# Altium schematic sheet fpga.SchDoc (part 2 of 3) (continued)
## Nets (continued)
NetJ5_27: J5.27(US_N) R75.6
NetJ5_28: J5.28(US_P) R73.6
NetJ5_29: J5.29(US_N) R75.5
NetJ5_30: J5.30(US_P) R73.5
NetJ5_31: J5.31(US_N) R120.8
NetJ5_32: J5.32(US_P) R118.8
NetJ5_33: J5.33(US_N) R120.7
NetJ5_34: J5.34(US_P) R118.7
NetJ5_35: J5.35(US_N) R120.6
NetJ5_36: J5.36(US_P) R118.6
NetJ5_37: J5.37(US_N) R120.5
NetJ5_38: J5.38(US_P) R118.5
NetJ5_39: J5.39(US_N) R119.8
NetJ5_40: J5.40(US_P) R117.8
NetJ5_41: J5.41(US_N) R119.7
NetJ5_42: J5.42(US_P) R117.7
NetJ5_43: J5.43(US_N) R119.6
NetJ5_44: J5.44(US_P) R117.6
NetJ5_45: J5.45(US_N) R119.5
NetJ5_46: J5.46(US_P) R117.5
NetJ5_47: J5.47(US_N) R116.8
NetJ5_48: J5.48(US_P) R114.8
NetJ5_49: J5.49(US_N) R116.7
NetJ5_50: J5.50(US_P) R114.7
NetJ5_51: J5.51(US_N) R116.6
NetJ5_52: J5.52(US_P) R114.6
NetJ5_53: J5.53(US_N) R116.5
NetJ5_54: J5.54(US_P) R114.5
NetJ5_55: J5.55(US_N) R115.8
NetJ5_56: J5.56(US_P) R113.8
NetJ5_57: J5.57(US_N) R115.7
NetJ5_58: J5.58(US_P) R113.7
NetJ5_59: J5.59(US_N) R115.6
NetJ5_60: J5.60(US_P) R113.6
NetJ5_61: J5.61(US_N) R115.5
NetJ5_62: J5.62(US_P) R113.5
NetJ5_63: J5.63(US_N) R112.8
NetJ5_64: J5.64(US_P) R110.8
NetJ5_65: J5.65(US_N) R112.7
NetJ5_66: J5.66(US_P) R110.7
NetJ5_67: J5.67(US_N) R112.6
NetJ5_68: J5.68(US_P) R110.6
NetJ5_69: J5.69(US_N) R112.5
NetJ5_70: J5.70(US_P) R110.5
NetJ5_71: J5.71(US_N) R111.8
NetJ5_72: J5.72(US_P) R109.8
NetJ5_73: J5.73(US_N) R111.7
NetJ5_74: J5.74(US_P) R109.7
NetJ5_75: J5.75(US_N) R111.6
NetJ5_76: J5.76(US_P) R109.6
NetJ5_77: J5.77(US_N) R111.5
NetJ5_78: J5.78(US_P) R109.5
NetJ5_79: J5.79(US_N) R108.8
NetJ5_80: J5.80(US_P) R106.8
NetJ5_81: J5.81(US_N) R108.7
NetJ5_82: J5.82(US_P) R106.7
NetJ5_83: J5.83(US_N) R108.6
NetJ5_84: J5.84(US_P) R106.6
NetJ5_85: J5.85(US_N) R108.5
NetJ5_86: J5.86(US_P) R106.5
NetJ5_87: J5.87(US_N) R107.8
NetJ5_88: J5.88(US_P) R105.8
NetJ5_89: J5.89(US_N) R107.7
NetJ5_90: J5.90(US_P) R105.7
NetJ5_91: J5.91(US_N) R107.6
NetJ5_92: J5.92(US_P) R105.6
NetJ5_93: J5.93(US_N) R107.5
NetJ5_94: J5.94(US_P) R105.5
NetJ5_95: J5.95(US_N) R103.5
NetJ5_96: J5.96(US_P) R101.5
NetJ6_7: J6.7(US_N) R103.6
NetJ6_8: J6.8(US_P) R101.6
NetJ6_9: J6.9(US_N) R103.7
NetJ6_10: J6.10(US_P) R101.7
NetJ6_11: J6.11(US_N) R103.8
NetJ6_12: J6.12(US_P) R101.8
NetJ6_13: J6.13(US_N) R104.5
NetJ6_14: J6.14(US_P) R102.5
NetJ6_15: J6.15(US_N) R104.6
NetJ6_16: J6.16(US_P) R102.6
NetJ6_17: J6.17(US_N) R104.7
NetJ6_18: J6.18(US_P) R102.7
NetJ6_19: J6.19(US_N) R104.8
NetJ6_20: J6.20(US_P) R102.8
NetJ6_21: J6.21(US_N) R99.5
NetJ6_22: J6.22(US_P) R97.5
NetJ6_23: J6.23(US_N) R99.6
NetJ6_24: J6.24(US_P) R97.6
NetJ6_25: J6.25(US_N) R99.7
NetJ6_26: J6.26(US_P) R97.7
NetJ6_27: J6.27(US_N) R99.8
NetJ6_28: J6.28(US_P) R97.8
NetJ6_29: J6.29(US_N) R100.5
NetJ6_30: J6.30(US_P) R98.5
NetJ6_31: J6.31(US_N) R100.6
NetJ6_32: J6.32(US_P) R98.6
NetJ6_33: J6.33(US_N) R100.7
NetJ6_34: J6.34(US_P) R98.7
NetJ6_35: J6.35(US_N) R100.8
NetJ6_36: J6.36(US_P) R98.8
NetJ6_37: J6.37(US_N) R135.5
NetJ6_38: J6.38(US_P) R133.5
NetJ6_39: J6.39(US_N) R135.6
NetJ6_40: J6.40(US_P) R133.6
NetJ6_41: J6.41(US_N) R135.7
NetJ6_42: J6.42(US_P) R133.7
NetJ6_43: J6.43(US_N) R135.8
NetJ6_44: J6.44(US_P) R133.8
NetJ6_45: J6.45(US_N) R136.5
NetJ6_46: J6.46(US_P) R134.5
NetJ6_47: J6.47(US_N) R136.6
NetJ6_48: J6.48(US_P) R134.6
NetJ6_49: J6.49(US_N) R136.7
NetJ6_50: J6.50(US_P) R134.7
NetJ6_51: J6.51(US_N) R136.8
NetJ6_52: J6.52(US_P) R134.8
NetJ6_53: J6.53(US_N) R131.5
NetJ6_54: J6.54(US_P) R129.5
NetJ6_55: J6.55(US_N) R131.6
NetJ6_56: J6.56(US_P) R129.6
NetJ6_57: J6.57(US_N) R131.7
NetJ6_58: J6.58(US_P) R129.7
NetJ6_59: J6.59(US_N) R131.8
NetJ6_60: J6.60(US_P) R129.8
NetJ6_61: J6.61(US_N) R132.5
NetJ6_62: J6.62(US_P) R130.5
NetJ6_63: J6.63(US_N) R132.6
NetJ6_64: J6.64(US_P) R130.6
NetJ6_65: J6.65(US_N) R132.7
NetJ6_66: J6.66(US_P) R130.7
NetJ6_67: J6.67(US_N) R132.8
NetJ6_68: J6.68(US_P) R130.8
NetJ6_69: J6.69(US_N) R127.5
NetJ6_70: J6.70(US_P) R125.5
NetJ6_71: J6.71(US_N) R127.6
NetJ6_72: J6.72(US_P) R125.6
NetJ6_73: J6.73(US_N) R127.7
NetJ6_74: J6.74(US_P) R125.7
NetJ6_75: J6.75(US_N) R127.8
NetJ6_76: J6.76(US_P) R125.8
NetJ6_77: J6.77(US_N) R128.5
NetJ6_78: J6.78(US_P) R126.5
NetJ6_79: J6.79(US_N) R128.6
NetJ6_80: J6.80(US_P) R126.6
NetJ6_81: J6.81(US_N) R128.7
NetJ6_82: J6.82(US_P) R126.7
NetJ6_83: J6.83(US_N) R128.8
NetJ6_84: J6.84(US_P) R126.8
NetJ6_85: J6.85(US_N) R123.5
NetJ6_86: J6.86(US_P) R121.5
NetJ6_87: J6.87(US_N) R123.6
NetJ6_88: J6.88(US_P) R121.6
NetJ6_89: J6.89(US_N) R123.7
NetJ6_90: J6.90(US_P) R121.7
NetJ6_91: J6.91(US_N) R123.8
NetJ6_92: J6.92(US_P) R121.8
NetJ6_93: J6.93(US_N) R124.5
NetJ6_94: J6.94(US_P) R122.5
NetJ6_95: J6.95(US_N) R124.6
NetJ6_96: J6.96(US_P) R122.6
NetJ7_7: J7.7(US_N) R124.7
NetJ7_8: J7.8(US_P) R122.7
NetJ7_9: J7.9(US_N) R124.8
NetJ7_10: J7.10(US_P) R122.8
NetJ7_11: J7.11(US_N) R144.8
NetJ7_12: J7.12(US_P) R142.8
NetJ7_13: J7.13(US_N) R144.7
NetJ7_14: J7.14(US_P) R142.7
NetJ7_15: J7.15(US_N) R144.6
NetJ7_16: J7.16(US_P) R142.6
NetJ7_17: J7.17(US_N) R144.5
NetJ7_18: J7.18(US_P) R142.5
NetJ7_19: J7.19(US_N) R143.8
NetJ7_20: J7.20(US_P) R141.8
NetJ7_21: J7.21(US_N) R143.7
NetJ7_22: J7.22(US_P) R141.7
NetJ7_23: J7.23(US_N) R143.6
NetJ7_24: J7.24(US_P) R141.6
NetJ7_25: J7.25(US_N) R143.5
NetJ7_26: J7.26(US_P) R141.5
NetJ7_27: J7.27(US_N) R140.8
NetJ7_28: J7.28(US_P) R138.8
NetJ7_29: J7.29(US_N) R140.7
NetJ7_30: J7.30(US_P) R138.7
NetJ7_31: J7.31(US_N) R140.6
NetJ7_32: J7.32(US_P) R138.6
NetJ7_33: J7.33(US_N) R140.5
NetJ7_34: J7.34(US_P) R138.5
NetJ7_35: J7.35(US_N) R139.8
NetJ7_36: J7.36(US_P) R137.8
NetJ7_37: J7.37(US_N) R139.7
NetJ7_38: J7.38(US_P) R137.7
NetJ7_39: J7.39(US_N) R139.6
NetJ7_40: J7.40(US_P) R137.6
NetJ7_41: J7.41(US_N) R139.5
NetJ7_42: J7.42(US_P) R137.5
NetJ7_43: J7.43(US_N) R156.8
NetJ7_44: J7.44(US_P) R154.8
NetJ7_45: J7.45(US_N) R156.7
NetJ7_46: J7.46(US_P) R154.7
NetJ7_47: J7.47(US_N) R156.6
NetJ7_48: J7.48(US_P) R154.6
NetJ7_49: J7.49(US_N) R156.5
NetJ7_50: J7.50(US_P) R154.5
NetJ7_51: J7.51(US_N) R155.8
NetJ7_52: J7.52(US_P) R153.8
NetJ7_53: J7.53(US_N) R155.7
NetJ7_54: J7.54(US_P) R153.7
NetJ7_55: J7.55(US_N) R155.6
NetJ7_56: J7.56(US_P) R153.6
NetJ7_57: J7.57(US_N) R155.5
NetJ7_58: J7.58(US_P) R153.5
NetJ7_59: J7.59(US_N) R152.8
NetJ7_60: J7.60(US_P) R150.8
NetJ7_61: J7.61(US_N) R152.7
NetJ7_62: J7.62(US_P) R150.7
NetJ7_63: J7.63(US_N) R152.6
NetJ7_64: J7.64(US_P) R150.6
NetJ7_65: J7.65(US_N) R152.5
NetJ7_66: J7.66(US_P) R150.5
NetJ7_67: J7.67(US_N) R151.8
NetJ7_68: J7.68(US_P) R149.8
NetJ7_69: J7.69(US_N) R151.7
NetJ7_70: J7.70(US_P) R149.7
NetJ7_71: J7.71(US_N) R151.6
NetJ7_72: J7.72(US_P) R149.6
NetJ7_73: J7.73(US_N) R151.5
NetJ7_74: J7.74(US_P) R149.5
NetJ7_75: J7.75(US_N) R148.8
NetJ7_76: J7.76(US_P) R146.8
NetJ7_77: J7.77(US_N) R148.7
NetJ7_78: J7.78(US_P) R146.7
NetJ7_79: J7.79(US_N) R148.6
NetJ7_80: J7.80(US_P) R146.6
NetJ7_81: J7.81(US_N) R148.5
NetJ7_82: J7.82(US_P) R146.5
NetJ7_83: J7.83(US_N) R147.8
NetJ7_84: J7.84(US_P) R145.8
NetJ7_85: J7.85(US_N) R147.7
NetJ7_86: J7.86(US_P) R145.7
NetJ7_87: J7.87(US_N) R147.6
NetJ7_88: J7.88(US_P) R145.6
NetJ7_89: J7.89(US_N) R147.5
NetJ7_90: J7.90(US_P) R145.5
NetJ7_91: J7.91(US_N) R167.5
NetJ7_92: J7.92(US_P) R165.5
NetJ7_93: J7.93(US_N) R167.6
NetJ7_94: J7.94(US_P) R165.6
NetJ7_95: J7.95(US_N) R167.7
NetJ7_96: J7.96(US_P) R165.7
NetJ8_7: J8.7(US_N) R167.8
NetJ8_8: J8.8(US_P) R165.8
NetJ8_9: J8.9(US_N) R168.5
NetJ8_10: J8.10(US_P) R166.5
NetJ8_11: J8.11(US_N) R168.6
NetJ8_12: J8.12(US_P) R166.6
NetJ8_13: J8.13(US_N) R168.7
NetJ8_14: J8.14(US_P) R166.7
NetJ8_15: J8.15(US_N) R168.8
NetJ8_16: J8.16(US_P) R166.8
NetJ8_17: J8.17(US_N) R163.5
NetJ8_18: J8.18(US_P) R161.5
NetJ8_19: J8.19(US_N) R163.6
NetJ8_20: J8.20(US_P) R161.6
NetJ8_21: J8.21(US_N) R163.7
NetJ8_22: J8.22(US_P) R161.7
NetJ8_23: J8.23(US_N) R163.8
NetJ8_24: J8.24(US_P) R161.8
NetJ8_25: J8.25(US_N) R164.5
NetJ8_26: J8.26(US_P) R162.5
NetJ8_27: J8.27(US_N) R164.6
NetJ8_28: J8.28(US_P) R162.6
NetJ8_29: J8.29(US_N) R164.7
NetJ8_30: J8.30(US_P) R162.7
NetJ8_31: J8.31(US_N) R164.8
NetJ8_32: J8.32(US_P) R162.8
NetJ8_33: J8.33(US_N) R159.5
NetJ8_34: J8.34(US_P) R157.5
NetJ8_35: J8.35(US_N) R159.6
NetJ8_36: J8.36(US_P) R157.6
NetJ8_37: J8.37(US_N) R159.7
NetJ8_38: J8.38(US_P) R157.7
NetJ8_39: J8.39(US_N) R159.8
NetJ8_40: J8.40(US_P) R157.8
NetJ8_41: J8.41(US_N) R160.5
NetJ8_42: J8.42(US_P) R158.5
NetJ8_43: J8.43(US_N) R160.6
NetJ8_44: J8.44(US_P) R158.6
NetJ8_45: J8.45(US_N) R160.7
NetJ8_46: J8.46(US_P) R158.7
NetJ8_47: J8.47(US_N) R160.8
NetJ8_48: J8.48(US_P) R158.8
NetJ8_49: J8.49(US_N) R179.5
NetJ8_50: J8.50(US_P) R177.5
NetJ8_51: J8.51(US_N) R179.6
NetJ8_52: J8.52(US_P) R177.6
NetJ8_53: J8.53(US_N) R179.7
NetJ8_54: J8.54(US_P) R177.7
NetJ8_55: J8.55(US_N) R179.8
NetJ8_56: J8.56(US_P) R177.8
NetJ8_57: J8.57(US_N) R180.5
NetJ8_58: J8.58(US_P) R178.5
NetJ8_59: J8.59(US_N) R180.6
NetJ8_60: J8.60(US_P) R178.6
NetJ8_61: J8.61(US_N) R180.7
NetJ8_62: J8.62(US_P) R178.7
NetJ8_63: J8.63(US_N) R180.8
NetJ8_64: J8.64(US_P) R178.8
NetJ8_65: J8.65(US_N) R175.5
NetJ8_66: J8.66(US_P) R173.5
NetJ8_67: J8.67(US_N) R175.6
NetJ8_68: J8.68(US_P) R173.6
NetJ8_69: J8.69(US_N) R175.7
NetJ8_70: J8.70(US_P) R173.7
NetJ8_71: J8.71(US_N) R175.8
NetJ8_72: J8.72(US_P) R173.8
NetJ8_73: J8.73(US_N) R176.5
NetJ8_74: J8.74(US_P) R174.5
NetJ8_75: J8.75(US_N) R176.6
NetJ8_76: J8.76(US_P) R174.6
NetJ8_77: J8.77(US_N) R176.7
NetJ8_78: J8.78(US_P) R174.7
NetJ8_79: J8.79(US_N) R176.8
NetJ8_80: J8.80(US_P) R174.8
NetJ8_81: J8.81(US_N) R171.5
NetJ8_82: J8.82(US_P) R169.5
NetJ8_83: J8.83(US_N) R171.6
NetJ8_84: J8.84(US_P) R169.6
NetJ8_85: J8.85(US_N) R171.7
NetJ8_86: J8.86(US_P) R169.7
NetJ8_87: J8.87(US_N) R171.8
NetJ8_88: J8.88(US_P) R169.8
NetJ8_89: J8.89(US_N) R172.5
NetJ8_90: J8.90(US_P) R170.5
NetJ8_91: J8.91(US_N) R172.6
NetJ8_92: J8.92(US_P) R170.6
NetJ8_93: J8.93(US_N) R172.7
NetJ8_94: J8.94(US_P) R170.7
NetJ8_95: J8.95(US_N) R172.8
NetJ8_96: J8.96(US_P) R170.8
NetR1_1: R1.1 U1.3(QD)
NetR1_2: R1.2 U1.2(QC)
NetR1_3: R1.3 U1.1(QB)
NetR1_4: R1.4 U1.15(QA)
NetR2_1: R2.1 U2.3(QD)
NetR2_2: R2.2 U2.2(QC)
NetR2_3: R2.3 U2.1(QB)
NetR2_4: R2.4 U2.15(QA)
NetR3_1: R3.1 U1.7(QH)
NetR3_2: R3.2 U1.6(QG)
NetR3_3: R3.3 U1.5(QF)
NetR3_4: R3.4 U1.4(QE)
NetR4_1: R4.1 U2.7(QH)
NetR4_2: R4.2 U2.6(QG)
NetR4_3: R4.3 U2.5(QF)
NetR4_4: R4.4 U2.4(QE)
NetR5_1: R5.1 U3.3(QD)
NetR5_2: R5.2 U3.2(QC)
NetR5_3: R5.3 U3.1(QB)
NetR5_4: R5.4 U3.15(QA)
NetR6_1: R6.1 U4.3(QD)
NetR6_2: R6.2 U4.2(QC)
NetR6_3: R6.3 U4.1(QB)
NetR6_4: R6.4 U4.15(QA)
NetR7_1: R7.1 U3.7(QH)
NetR7_2: R7.2 U3.6(QG)
NetR7_3: R7.3 U3.5(QF)
NetR7_4: R7.4 U3.4(QE)
NetR8_1: R8.1 U4.7(QH)
NetR8_2: R8.2 U4.6(QG)
NetR8_3: R8.3 U4.5(QF)
NetR8_4: R8.4 U4.4(QE)
NetR9_1: R9.1 U5.3(QD)
NetR9_2: R9.2 U5.2(QC)
NetR9_3: R9.3 U5.1(QB)
NetR9_4: R9.4 U5.15(QA)
NetR10_1: R10.1 U6.3(QD)
NetR10_2: R10.2 U6.2(QC)
NetR10_3: R10.3 U6.1(QB)
NetR10_4: R10.4 U6.15(QA)
NetR11_1: R11.1 U5.7(QH)
NetR11_2: R11.2 U5.6(QG)
NetR11_3: R11.3 U5.5(QF)
NetR11_4: R11.4 U5.4(QE)
NetR12_1: R12.1 U6.7(QH)
NetR12_2: R12.2 U6.6(QG)
NetR12_3: R12.3 U6.5(QF)
NetR12_4: R12.4 U6.4(QE)
NetR13_1: R13.1 U7.3(QD)
NetR13_2: R13.2 U7.2(QC)
NetR13_3: R13.3 U7.1(QB)
NetR13_4: R13.4 U7.15(QA)
NetR14_1: R14.1 U8.3(QD)
NetR14_2: R14.2 U8.2(QC)
NetR14_3: R14.3 U8.1(QB)
NetR14_4: R14.4 U8.15(QA)
NetR15_1: R15.1 U7.7(QH)
NetR15_2: R15.2 U7.6(QG)
NetR15_3: R15.3 U7.5(QF)
NetR15_4: R15.4 U7.4(QE)
NetR16_1: R16.1 U8.7(QH)
NetR16_2: R16.2 U8.6(QG)
NetR16_3: R16.3 U8.5(QF)
NetR16_4: R16.4 U8.4(QE)
NetR17_1: R17.1 U9.3(QD)
NetR17_2: R17.2 U9.2(QC)
NetR17_3: R17.3 U9.1(QB)
NetR17_4: R17.4 U9.15(QA)
NetR18_1: R18.1 U10.3(QD)
NetR18_2: R18.2 U10.2(QC)
NetR18_3: R18.3 U10.1(QB)
NetR18_4: R18.4 U10.15(QA)
NetR19_1: R19.1 U9.7(QH)
NetR19_2: R19.2 U9.6(QG)
NetR19_3: R19.3 U9.5(QF)
NetR19_4: R19.4 U9.4(QE)
NetR20_1: R20.1 U10.7(QH)
NetR20_2: R20.2 U10.6(QG)
NetR20_3: R20.3 U10.5(QF)
NetR20_4: R20.4 U10.4(QE)
NetR21_1: R21.1 U11.3(QD)
NetR21_2: R21.2 U11.2(QC)
NetR21_3: R21.3 U11.1(QB)
NetR21_4: R21.4 U11.15(QA)
NetR22_1: R22.1 U12.3(QD)
NetR22_2: R22.2 U12.2(QC)
NetR22_3: R22.3 U12.1(QB)
NetR22_4: R22.4 U12.15(QA)
NetR23_1: R23.1 U11.7(QH)
NetR23_2: R23.2 U11.6(QG)
NetR23_3: R23.3 U11.5(QF)
NetR23_4: R23.4 U11.4(QE)
NetR24_1: R24.1 U12.7(QH)
NetR24_2: R24.2 U12.6(QG)
NetR24_3: R24.3 U12.5(QF)
NetR24_4: R24.4 U12.4(QE)
NetR25_1: R25.1 U13.3(QD)
NetR25_2: R25.2 U13.2(QC)
NetR25_3: R25.3 U13.1(QB)
NetR25_4: R25.4 U13.15(QA)
NetR26_1: R26.1 U14.3(QD)
NetR26_2: R26.2 U14.2(QC)
NetR26_3: R26.3 U14.1(QB)
NetR26_4: R26.4 U14.15(QA)
NetR27_1: R27.1 U13.7(QH)
NetR27_2: R27.2 U13.6(QG)
NetR27_3: R27.3 U13.5(QF)
NetR27_4: R27.4 U13.4(QE)
NetR28_1: R28.1 U14.7(QH)
NetR28_2: R28.2 U14.6(QG)
NetR28_3: R28.3 U14.5(QF)
NetR28_4: R28.4 U14.4(QE)
NetR29_1: R29.1 U15.3(QD)
NetR29_2: R29.2 U15.2(QC)
NetR29_3: R29.3 U15.1(QB)
NetR29_4: R29.4 U15.15(QA)
NetR30_1: R30.1 U16.3(QD)
NetR30_2: R30.2 U16.2(QC)
NetR30_3: R30.3 U16.1(QB)
NetR30_4: R30.4 U16.15(QA)
NetR31_1: R31.1 U15.7(QH)
NetR31_2: R31.2 U15.6(QG)
NetR31_3: R31.3 U15.5(QF)
NetR31_4: R31.4 U15.4(QE)
NetR32_1: R32.1 U16.7(QH)
NetR32_2: R32.2 U16.6(QG)
NetR32_3: R32.3 U16.5(QF)
NetR32_4: R32.4 U16.4(QE)
NetR33_1: R33.1 U17.3(QD)
NetR33_2: R33.2 U17.2(QC)
NetR33_3: R33.3 U17.1(QB)
NetR33_4: R33.4 U17.15(QA)
NetR34_1: R34.1 U18.3(QD)
NetR34_2: R34.2 U18.2(QC)
NetR34_3: R34.3 U18.1(QB)
NetR34_4: R34.4 U18.15(QA)
NetR35_1: R35.1 U17.7(QH)
NetR35_2: R35.2 U17.6(QG)
NetR35_3: R35.3 U17.5(QF)
NetR35_4: R35.4 U17.4(QE)
NetR36_1: R36.1 U18.7(QH)
NetR36_2: R36.2 U18.6(QG)
NetR36_3: R36.3 U18.5(QF)
NetR36_4: R36.4 U18.4(QE)
NetR37_1: R37.1 U19.3(QD)
NetR37_2: R37.2 U19.2(QC)
NetR37_3: R37.3 U19.1(QB)
NetR37_4: R37.4 U19.15(QA)
NetR38_1: R38.1 U20.3(QD)
NetR38_2: R38.2 U20.2(QC)
NetR38_3: R38.3 U20.1(QB)
NetR38_4: R38.4 U20.15(QA)
NetR39_1: R39.1 U19.7(QH)
NetR39_2: R39.2 U19.6(QG)
NetR39_3: R39.3 U19.5(QF)
NetR39_4: R39.4 U19.4(QE)
NetR40_1: R40.1 U20.7(QH)
NetR40_2: R40.2 U20.6(QG)
NetR40_3: R40.3 U20.5(QF)
NetR40_4: R40.4 U20.4(QE)
NetR41_1: R41.1 U21.3(QD)
NetR41_2: R41.2 U21.2(QC)
NetR41_3: R41.3 U21.1(QB)
NetR41_4: R41.4 U21.15(QA)
NetR42_1: R42.1 U22.3(QD)
NetR42_2: R42.2 U22.2(QC)
NetR42_3: R42.3 U22.1(QB)
NetR42_4: R42.4 U22.15(QA)
NetR43_1: R43.1 U21.7(QH)
NetR43_2: R43.2 U21.6(QG)
NetR43_3: R43.3 U21.5(QF)
NetR43_4: R43.4 U21.4(QE)
NetR44_1: R44.1 U22.7(QH)
NetR44_2: R44.2 U22.6(QG)
NetR44_3: R44.3 U22.5(QF)
NetR44_4: R44.4 U22.4(QE)
NetR45_1: R45.1 U23.3(QD)
NetR45_2: R45.2 U23.2(QC)
NetR45_3: R45.3 U23.1(QB)
NetR45_4: R45.4 U23.15(QA)
NetR46_1: R46.1 U24.3(QD)
NetR46_2: R46.2 U24.2(QC)
NetR46_3: R46.3 U24.1(QB)
NetR46_4: R46.4 U24.15(QA)
NetR47_1: R47.1 U23.7(QH)
NetR47_2: R47.2 U23.6(QG)
NetR47_3: R47.3 U23.5(QF)
NetR47_4: R47.4 U23.4(QE)
NetR48_1: R48.1 U24.7(QH)
NetR48_2: R48.2 U24.6(QG)
NetR48_3: R48.3 U24.5(QF)
NetR48_4: R48.4 U24.4(QE)
NetR49_1: R49.1 U27.3(QD)
NetR49_2: R49.2 U27.2(QC)
NetR49_3: R49.3 U27.1(QB)
NetR49_4: R49.4 U27.15(QA)
NetR50_1: R50.1 U27.7(QH)
NetR50_2: R50.2 U27.6(QG)
NetR50_3: R50.3 U27.5(QF)
NetR50_4: R50.4 U27.4(QE)
NetR51_1: R51.1 U28.3(QD)
NetR51_2: R51.2 U28.2(QC)
NetR51_3: R51.3 U28.1(QB)
NetR51_4: R51.4 U28.15(QA)
NetR52_1: R52.1 U28.7(QH)
NetR52_2: R52.2 U28.6(QG)
NetR52_3: R52.3 U28.5(QF)
NetR52_4: R52.4 U28.4(QE)
NetR53_1: R53.1 U29.3(QD)
NetR53_2: R53.2 U29.2(QC)
NetR53_3: R53.3 U29.1(QB)
NetR53_4: R53.4 U29.15(QA)
NetR54_1: R54.1 U29.7(QH)
NetR54_2: R54.2 U29.6(QG)
NetR54_3: R54.3 U29.5(QF)
NetR54_4: R54.4 U29.4(QE)
NetR55_1: R55.1 U30.3(QD)
NetR55_2: R55.2 U30.2(QC)
NetR55_3: R55.3 U30.1(QB)
NetR55_4: R55.4 U30.15(QA)
NetR56_1: R56.1 U30.7(QH)
NetR56_2: R56.2 U30.6(QG)
NetR56_3: R56.3 U30.5(QF)
NetR56_4: R56.4 U30.4(QE)
NetR57_1: R57.1 U31.3(QD)
NetR57_2: R57.2 U31.2(QC)
NetR57_3: R57.3 U31.1(QB)
NetR57_4: R57.4 U31.15(QA)
NetR58_1: R58.1 U31.7(QH)
NetR58_2: R58.2 U31.6(QG)
NetR58_3: R58.3 U31.5(QF)
NetR58_4: R58.4 U31.4(QE)
NetR59_1: R59.1 U32.3(QD)
NetR59_2: R59.2 U32.2(QC)
NetR59_3: R59.3 U32.1(QB)
NetR59_4: R59.4 U32.15(QA)
NetR60_1: R60.1 U32.7(QH)
NetR60_2: R60.2 U32.6(QG)
NetR60_3: R60.3 U32.5(QF)
NetR60_4: R60.4 U32.4(QE)
NetR61_1: R61.1 U33.3(QD)
NetR61_2: R61.2 U33.2(QC)
NetR61_3: R61.3 U33.1(QB)
NetR61_4: R61.4 U33.15(QA)
NetR62_1: R62.1 U33.7(QH)
NetR62_2: R62.2 U33.6(QG)
NetR62_3: R62.3 U33.5(QF)
NetR62_4: R62.4 U33.4(QE)
NetR63_1: R63.1 U34.3(QD)
NetR63_2: R63.2 U34.2(QC)
NetR63_3: R63.3 U34.1(QB)
NetR63_4: R63.4 U34.15(QA)
NetR64_1: R64.1 U34.7(QH)
NetR64_2: R64.2 U34.6(QG)
NetR64_3: R64.3 U34.5(QF)
NetR64_4: R64.4 U34.4(QE)
NetR65_1: R65.1 U35.3(QD)
NetR65_2: R65.2 U35.2(QC)
NetR65_3: R65.3 U35.1(QB)
NetR65_4: R65.4 U35.15(QA)
NetR66_1: R66.1 U35.7(QH)
NetR66_2: R66.2 U35.6(QG)
NetR66_3: R66.3 U35.5(QF)
NetR66_4: R66.4 U35.4(QE)
NetR67_1: R67.1 U36.3(QD)
NetR67_2: R67.2 U36.2(QC)
NetR67_3: R67.3 U36.1(QB)
NetR67_4: R67.4 U36.15(QA)
NetR68_1: R68.1 U36.7(QH)
NetR68_2: R68.2 U36.6(QG)
NetR68_3: R68.3 U36.5(QF)
NetR68_4: R68.4 U36.4(QE)
NetR69_1: R69.1 U37.3(QD)
NetR69_2: R69.2 U37.2(QC)
NetR69_3: R69.3 U37.1(QB)
NetR69_4: R69.4 U37.15(QA)
NetR70_1: R70.1 U37.7(QH)
NetR70_2: R70.2 U37.6(QG)
NetR70_3: R70.3 U37.5(QF)
NetR70_4: R70.4 U37.4(QE)
NetR71_1: R71.1 U38.3(QD)
NetR71_2: R71.2 U38.2(QC)
NetR71_3: R71.3 U38.1(QB)
NetR71_4: R71.4 U38.15(QA)
NetR72_1: R72.1 U38.7(QH)
NetR72_2: R72.2 U38.6(QG)
NetR72_3: R72.3 U38.5(QF)
NetR72_4: R72.4 U38.4(QE)
NetR73_1: R73.1 U39.3(QD)
NetR73_2: R73.2 U39.2(QC)
NetR73_3: R73.3 U39.1(QB)
NetR73_4: R73.4 U39.15(QA)
NetR74_1: R74.1 U39.7(QH)
NetR74_2: R74.2 U39.6(QG)
NetR74_3: R74.3 U39.5(QF)
NetR74_4: R74.4 U39.4(QE)
NetR75_1: R75.1 U40.3(QD)
NetR75_2: R75.2 U40.2(QC)
NetR75_3: R75.3 U40.1(QB)
NetR75_4: R75.4 U40.15(QA)
NetR76_1: R76.1 U40.7(QH)
NetR76_2: R76.2 U40.6(QG)
NetR76_3: R76.3 U40.5(QF)
NetR76_4: R76.4 U40.4(QE)
NetR77_1: R77.1 U41.3(QD)
NetR77_2: R77.2 U41.2(QC)
NetR77_3: R77.3 U41.1(QB)
NetR77_4: R77.4 U41.15(QA)
NetR78_1: R78.1 U41.7(QH)
NetR78_2: R78.2 U41.6(QG)
NetR78_3: R78.3 U41.5(QF)
NetR78_4: R78.4 U41.4(QE)
NetR79_1: R79.1 U42.3(QD)
NetR79_2: R79.2 U42.2(QC)
NetR79_3: R79.3 U42.1(QB)
NetR79_4: R79.4 U42.15(QA)
NetR80_1: R80.1 U42.7(QH)
NetR80_2: R80.2 U42.6(QG)
NetR80_3: R80.3 U42.5(QF)
NetR80_4: R80.4 U42.4(QE)
NetR81_1: R81.1 U43.3(QD)
NetR81_2: R81.2 U43.2(QC)
NetR81_3: R81.3 U43.1(QB)
NetR81_4: R81.4 U43.15(QA)
NetR82_1: R82.1 U43.7(QH)
NetR82_2: R82.2 U43.6(QG)
NetR82_3: R82.3 U43.5(QF)
NetR82_4: R82.4 U43.4(QE)
NetR83_1: R83.1 U44.3(QD)
NetR83_2: R83.2 U44.2(QC)
NetR83_3: R83.3 U44.1(QB)
NetR83_4: R83.4 U44.15(QA)
NetR84_1: R84.1 U44.7(QH)
NetR84_2: R84.2 U44.6(QG)
NetR84_3: R84.3 U44.5(QF)
NetR84_4: R84.4 U44.4(QE)
NetR85_1: R85.1 U45.3(QD)
NetR85_2: R85.2 U45.2(QC)
NetR85_3: R85.3 U45.1(QB)
NetR85_4: R85.4 U45.15(QA)
NetR86_1: R86.1 U45.7(QH)
NetR86_2: R86.2 U45.6(QG)
NetR86_3: R86.3 U45.5(QF)
NetR86_4: R86.4 U45.4(QE)
NetR87_1: R87.1 U46.3(QD)
NetR87_2: R87.2 U46.2(QC)
NetR87_3: R87.3 U46.1(QB)
NetR87_4: R87.4 U46.15(QA)
NetR88_1: R88.1 U46.7(QH)
NetR88_2: R88.2 U46.6(QG)
NetR88_3: R88.3 U46.5(QF)
NetR88_4: R88.4 U46.4(QE)
NetR89_1: R89.1 U47.3(QD)
NetR89_2: R89.2 U47.2(QC)
NetR89_3: R89.3 U47.1(QB)
NetR89_4: R89.4 U47.15(QA)
NetR90_1: R90.1 U47.7(QH)
NetR90_2: R90.2 U47.6(QG)
NetR90_3: R90.3 U47.5(QF)
NetR90_4: R90.4 U47.4(QE)
NetR91_1: R91.1 U48.3(QD)
NetR91_2: R91.2 U48.2(QC)
NetR91_3: R91.3 U48.1(QB)
NetR91_4: R91.4 U48.15(QA)
NetR92_1: R92.1 U48.7(QH)
NetR92_2: R92.2 U48.6(QG)
NetR92_3: R92.3 U48.5(QF)
NetR92_4: R92.4 U48.4(QE)
NetR93_1: R93.1 U49.3(QD)
NetR93_2: R93.2 U49.2(QC)
NetR93_3: R93.3 U49.1(QB)
NetR93_4: R93.4 U49.15(QA)
NetR94_1: R94.1 U49.7(QH)
NetR94_2: R94.2 U49.6(QG)
NetR94_3: R94.3 U49.5(QF)
NetR94_4: R94.4 U49.4(QE)
NetR95_1: R95.1 U50.3(QD)
NetR95_2: R95.2 U50.2(QC)
NetR95_3: R95.3 U50.1(QB)
NetR95_4: R95.4 U50.15(QA)
NetR96_1: R96.1 U50.7(QH)
NetR96_2: R96.2 U50.6(QG)
NetR96_3: R96.3 U50.5(QF)
NetR96_4: R96.4 U50.4(QE)
NetR97_1: R97.1 U51.3(QD)
NetR97_2: R97.2 U51.2(QC)
NetR97_3: R97.3 U51.1(QB)
NetR97_4: R97.4 U51.15(QA)
NetR98_1: R98.1 U51.7(QH)
NetR98_2: R98.2 U51.6(QG)
NetR98_3: R98.3 U51.5(QF)
NetR98_4: R98.4 U51.4(QE)
NetR99_1: R99.1 U52.3(QD)
NetR99_2: R99.2 U52.2(QC)
NetR99_3: R99.3 U52.1(QB)
NetR99_4: R99.4 U52.15(QA)
NetR100_1: R100.1 U52.7(QH)
NetR100_2: R100.2 U52.6(QG)
NetR100_3: R100.3 U52.5(QF)
NetR100_4: R100.4 U52.4(QE)
NetR101_1: R101.1 U53.3(QD)
NetR101_2: R101.2 U53.2(QC)
NetR101_3: R101.3 U53.1(QB)
NetR101_4: R101.4 U53.15(QA)
NetR102_1: R102.1 U53.7(QH)
NetR102_2: R102.2 U53.6(QG)
NetR102_3: R102.3 U53.5(QF)
NetR102_4: R102.4 U53.4(QE)
NetR103_1: R103.1 U54.3(QD)
NetR103_2: R103.2 U54.2(QC)
NetR103_3: R103.3 U54.1(QB)
NetR103_4: R103.4 U54.15(QA)
NetR104_1: R104.1 U54.7(QH)
NetR104_2: R104.2 U54.6(QG)
NetR104_3: R104.3 U54.5(QF)
NetR104_4: R104.4 U54.4(QE)
NetR105_1: R105.1 U55.3(QD)
NetR105_2: R105.2 U55.2(QC)
NetR105_3: R105.3 U55.1(QB)
NetR105_4: R105.4 U55.15(QA)
NetR106_1: R106.1 U55.7(QH)
NetR106_2: R106.2 U55.6(QG)
NetR106_3: R106.3 U55.5(QF)
NetR106_4: R106.4 U55.4(QE)
NetR107_1: R107.1 U56.3(QD)
NetR107_2: R107.2 U56.2(QC)
NetR107_3: R107.3 U56.1(QB)
NetR107_4: R107.4 U56.15(QA)
NetR108_1: R108.1 U56.7(QH)
NetR108_2: R108.2 U56.6(QG)
NetR108_3: R108.3 U56.5(QF)
NetR108_4: R108.4 U56.4(QE)
NetR109_1: R109.1 U57.3(QD)
NetR109_2: R109.2 U57.2(QC)
NetR109_3: R109.3 U57.1(QB)
NetR109_4: R109.4 U57.15(QA)
NetR110_1: R110.1 U57.7(QH)
NetR110_2: R110.2 U57.6(QG)
NetR110_3: R110.3 U57.5(QF)
NetR110_4: R110.4 U57.4(QE)
NetR111_1: R111.1 U58.3(QD)
NetR111_2: R111.2 U58.2(QC)
NetR111_3: R111.3 U58.1(QB)
NetR111_4: R111.4 U58.15(QA)
NetR112_1: R112.1 U58.7(QH)
NetR112_2: R112.2 U58.6(QG)
NetR112_3: R112.3 U58.5(QF)
NetR112_4: R112.4 U58.4(QE)
NetR113_1: R113.1 U59.3(QD)
NetR113_2: R113.2 U59.2(QC)
NetR113_3: R113.3 U59.1(QB)
NetR113_4: R113.4 U59.15(QA)
NetR114_1: R114.1 U59.7(QH)
NetR114_2: R114.2 U59.6(QG)
NetR114_3: R114.3 U59.5(QF)
NetR114_4: R114.4 U59.4(QE)
NetR115_1: R115.1 U60.3(QD)
NetR115_2: R115.2 U60.2(QC)
NetR115_3: R115.3 U60.1(QB)
NetR115_4: R115.4 U60.15(QA)
NetR116_1: R116.1 U60.7(QH)
NetR116_2: R116.2 U60.6(QG)
NetR116_3: R116.3 U60.5(QF)
NetR116_4: R116.4 U60.4(QE)
NetR117_1: R117.1 U61.3(QD)
NetR117_2: R117.2 U61.2(QC)
NetR117_3: R117.3 U61.1(QB)
NetR117_4: R117.4 U61.15(QA)
NetR118_1: R118.1 U61.7(QH)
NetR118_2: R118.2 U61.6(QG)
NetR118_3: R118.3 U61.5(QF)
NetR118_4: R118.4 U61.4(QE)
NetR119_1: R119.1 U62.3(QD)
NetR119_2: R119.2 U62.2(QC)
NetR119_3: R119.3 U62.1(QB)
NetR119_4: R119.4 U62.15(QA)
NetR120_1: R120.1 U62.7(QH)
NetR120_2: R120.2 U62.6(QG)
NetR120_3: R120.3 U62.5(QF)
NetR120_4: R120.4 U62.4(QE)
NetR121_1: R121.1 U63.3(QD)
NetR121_2: R121.2 U63.2(QC)
NetR121_3: R121.3 U63.1(QB)
NetR121_4: R121.4 U63.15(QA)
NetR122_1: R122.1 U63.7(QH)
NetR122_2: R122.2 U63.6(QG)
NetR122_3: R122.3 U63.5(QF)
NetR122_4: R122.4 U63.4(QE)
NetR123_1: R123.1 U64.3(QD)
NetR123_2: R123.2 U64.2(QC)
NetR123_3: R123.3 U64.1(QB)
NetR123_4: R123.4 U64.15(QA)
NetR124_1: R124.1 U64.7(QH)
NetR124_2: R124.2 U64.6(QG)
NetR124_3: R124.3 U64.5(QF)
NetR124_4: R124.4 U64.4(QE)
NetR125_1: R125.1 U65.3(QD)
NetR125_2: R125.2 U65.2(QC)
NetR125_3: R125.3 U65.1(QB)
NetR125_4: R125.4 U65.15(QA)
NetR126_1: R126.1 U65.7(QH)
NetR126_2: R126.2 U65.6(QG)
NetR126_3: R126.3 U65.5(QF)
NetR126_4: R126.4 U65.4(QE)
NetR127_1: R127.1 U66.3(QD)
NetR127_2: R127.2 U66.2(QC)
NetR127_3: R127.3 U66.1(QB)
NetR127_4: R127.4 U66.15(QA)
NetR128_1: R128.1 U66.7(QH)
NetR128_2: R128.2 U66.6(QG)
NetR128_3: R128.3 U66.5(QF)
NetR128_4: R128.4 U66.4(QE)
NetR129_1: R129.1 U67.3(QD)
NetR129_2: R129.2 U67.2(QC)
NetR129_3: R129.3 U67.1(QB)
NetR129_4: R129.4 U67.15(QA)
NetR130_1: R130.1 U67.7(QH)
NetR130_2: R130.2 U67.6(QG)
NetR130_3: R130.3 U67.5(QF)
NetR130_4: R130.4 U67.4(QE)
NetR131_1: R131.1 U68.3(QD)
NetR131_2: R131.2 U68.2(QC)
NetR131_3: R131.3 U68.1(QB)
NetR131_4: R131.4 U68.15(QA)
NetR132_1: R132.1 U68.7(QH)
NetR132_2: R132.2 U68.6(QG)
NetR132_3: R132.3 U68.5(QF)
NetR132_4: R132.4 U68.4(QE)
NetR133_1: R133.1 U69.3(QD)
NetR133_2: R133.2 U69.2(QC)
NetR133_3: R133.3 U69.1(QB)
NetR133_4: R133.4 U69.15(QA)
NetR134_1: R134.1 U69.7(QH)
NetR134_2: R134.2 U69.6(QG)
NetR134_3: R134.3 U69.5(QF)
NetR134_4: R134.4 U69.4(QE)
NetR135_1: R135.1 U70.3(QD)
NetR135_2: R135.2 U70.2(QC)
NetR135_3: R135.3 U70.1(QB)
NetR135_4: R135.4 U70.15(QA)
NetR136_1: R136.1 U70.7(QH)
NetR136_2: R136.2 U70.6(QG)
NetR136_3: R136.3 U70.5(QF)
NetR136_4: R136.4 U70.4(QE)
NetR137_1: R137.1 U71.3(QD)
NetR137_2: R137.2 U71.2(QC)
NetR137_3: R137.3 U71.1(QB)
NetR137_4: R137.4 U71.15(QA)
NetR138_1: R138.1 U71.7(QH)
NetR138_2: R138.2 U71.6(QG)
NetR138_3: R138.3 U71.5(QF)
NetR138_4: R138.4 U71.4(QE)
NetR139_1: R139.1 U72.3(QD)
NetR139_2: R139.2 U72.2(QC)
NetR139_3: R139.3 U72.1(QB)
NetR139_4: R139.4 U72.15(QA)
NetR140_1: R140.1 U72.7(QH)
NetR140_2: R140.2 U72.6(QG)
NetR140_3: R140.3 U72.5(QF)
NetR140_4: R140.4 U72.4(QE)
NetR141_1: R141.1 U73.3(QD)
NetR141_2: R141.2 U73.2(QC)
NetR141_3: R141.3 U73.1(QB)
NetR141_4: R141.4 U73.15(QA)
NetR142_1: R142.1 U73.7(QH)
NetR142_2: R142.2 U73.6(QG)
NetR142_3: R142.3 U73.5(QF)
NetR142_4: R142.4 U73.4(QE)
NetR143_1: R143.1 U74.3(QD)
NetR143_2: R143.2 U74.2(QC)
NetR143_3: R143.3 U74.1(QB)
NetR143_4: R143.4 U74.15(QA)
NetR144_1: R144.1 U74.7(QH)
NetR144_2: R144.2 U74.6(QG)
NetR144_3: R144.3 U74.5(QF)
NetR144_4: R144.4 U74.4(QE)
NetR145_1: R145.1 U75.3(QD)
NetR145_2: R145.2 U75.2(QC)
NetR145_3: R145.3 U75.1(QB)
NetR145_4: R145.4 U75.15(QA)
NetR146_1: R146.1 U75.7(QH)
NetR146_2: R146.2 U75.6(QG)
NetR146_3: R146.3 U75.5(QF)
NetR146_4: R146.4 U75.4(QE)
NetR147_1: R147.1 U76.3(QD)
NetR147_2: R147.2 U76.2(QC)
NetR147_3: R147.3 U76.1(QB)
NetR147_4: R147.4 U76.15(QA)
NetR148_1: R148.1 U76.7(QH)
NetR148_2: R148.2 U76.6(QG)
NetR148_3: R148.3 U76.5(QF)
NetR148_4: R148.4 U76.4(QE)
NetR149_1: R149.1 U77.3(QD)
NetR149_2: R149.2 U77.2(QC)
NetR149_3: R149.3 U77.1(QB)
NetR149_4: R149.4 U77.15(QA)
NetR150_1: R150.1 U77.7(QH)
NetR150_2: R150.2 U77.6(QG)
NetR150_3: R150.3 U77.5(QF)
NetR150_4: R150.4 U77.4(QE)
NetR151_1: R151.1 U78.3(QD)
NetR151_2: R151.2 U78.2(QC)
NetR151_3: R151.3 U78.1(QB)
NetR151_4: R151.4 U78.15(QA)
NetR152_1: R152.1 U78.7(QH)
NetR152_2: R152.2 U78.6(QG)
NetR152_3: R152.3 U78.5(QF)
NetR152_4: R152.4 U78.4(QE)
NetR153_1: R153.1 U79.3(QD)
NetR153_2: R153.2 U79.2(QC)
NetR153_3: R153.3 U79.1(QB)
NetR153_4: R153.4 U79.15(QA)
NetR154_1: R154.1 U79.7(QH)
NetR154_2: R154.2 U79.6(QG)
NetR154_3: R154.3 U79.5(QF)
NetR154_4: R154.4 U79.4(QE)
NetR155_1: R155.1 U80.3(QD)
NetR155_2: R155.2 U80.2(QC)
NetR155_3: R155.3 U80.1(QB)
NetR155_4: R155.4 U80.15(QA)
NetR156_1: R156.1 U80.7(QH)
NetR156_2: R156.2 U80.6(QG)
NetR156_3: R156.3 U80.5(QF)
NetR156_4: R156.4 U80.4(QE)
NetR157_1: R157.1 U81.3(QD)
NetR157_2: R157.2 U81.2(QC)
NetR157_3: R157.3 U81.1(QB)
NetR157_4: R157.4 U81.15(QA)
NetR158_1: R158.1 U81.7(QH)
NetR158_2: R158.2 U81.6(QG)
NetR158_3: R158.3 U81.5(QF)
NetR158_4: R158.4 U81.4(QE)
NetR159_1: R159.1 U82.3(QD)
NetR159_2: R159.2 U82.2(QC)
NetR159_3: R159.3 U82.1(QB)
NetR159_4: R159.4 U82.15(QA)
NetR160_1: R160.1 U82.7(QH)
NetR160_2: R160.2 U82.6(QG)
NetR160_3: R160.3 U82.5(QF)
NetR160_4: R160.4 U82.4(QE)
NetR161_1: R161.1 U83.3(QD)
NetR161_2: R161.2 U83.2(QC)
NetR161_3: R161.3 U83.1(QB)
NetR161_4: R161.4 U83.15(QA)
NetR162_1: R162.1 U83.7(QH)
NetR162_2: R162.2 U83.6(QG)
NetR162_3: R162.3 U83.5(QF)
NetR162_4: R162.4 U83.4(QE)
NetR163_1: R163.1 U84.3(QD)
NetR163_2: R163.2 U84.2(QC)
NetR163_3: R163.3 U84.1(QB)
NetR163_4: R163.4 U84.15(QA)
NetR164_1: R164.1 U84.7(QH)
NetR164_2: R164.2 U84.6(QG)
NetR164_3: R164.3 U84.5(QF)
NetR164_4: R164.4 U84.4(QE)
NetR165_1: R165.1 U85.3(QD)
NetR165_2: R165.2 U85.2(QC)
NetR165_3: R165.3 U85.1(QB)
NetR165_4: R165.4 U85.15(QA)
NetR166_1: R166.1 U85.7(QH)
NetR166_2: R166.2 U85.6(QG)